# Altium schematic sheet GSM.SchDoc: GSM Sheet
size A4; ApprovedBy: Krzysztof Belewicz; CheckedBy: Krzysztof Belewicz; Author: Krzysztof Belewicz, Paweł Pieńczuk; CompanyName: Koło Naukowe Systemów Scalonych; DrawnBy: Krzysztof Belewicz; Organization: KNSS; Address1: Koło Naukowe; Address2: Systemów Scalonych; Address3: 00-665 Warszawa; Address4: Nowowiejska 15/19; DocumentNumber: 2; Revision: 1.0; SheetNumber: 3; SheetTotal: 4
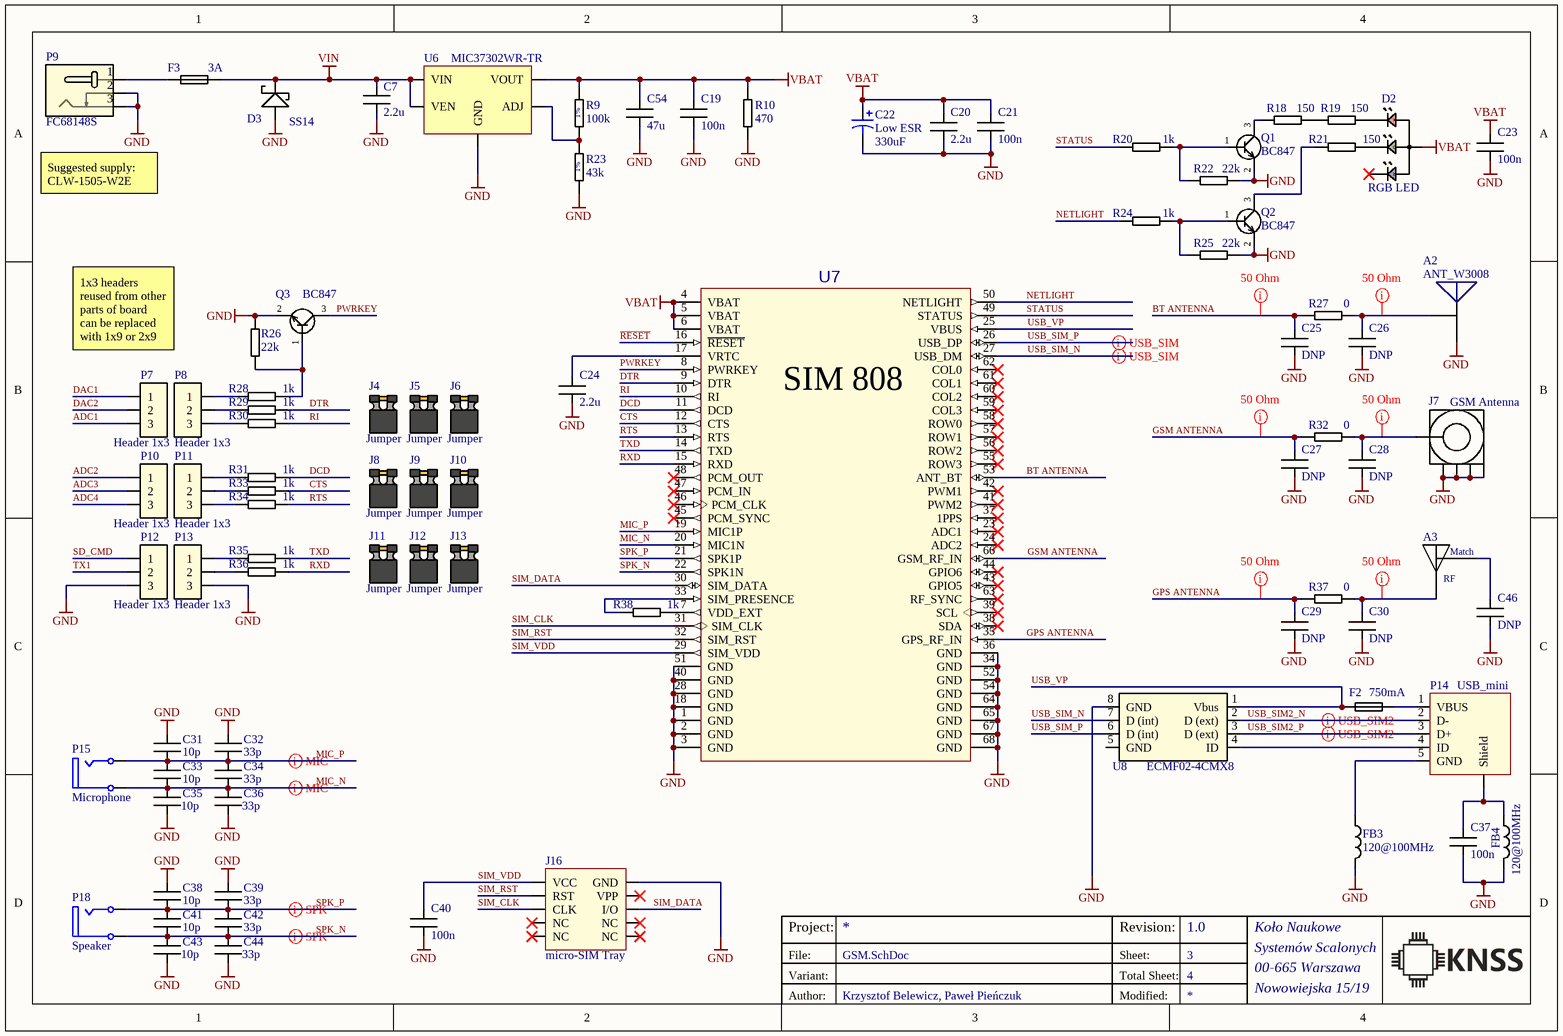
[diagram p0: GSM.SchDoc]

## Parts
A2  ANT_W3008  [W3008]
A3  GPS Antenna  [ANT3216_v2]  (value not drawn)
C7  value 2.2u  [CAPC1005N]  (hidden comment: Capacitor)
C19  100n  [CAPC1005N]
C20  value 2.2u  [CAPC1005N]  (hidden comment: Capacitor)
C21  100n  [CAPC1005N]
C22  Low ESR  value 330uF  [CAP 6.3x5.8]
C23  100n  [CAPC1005N]
C24  value 2.2u  [CAPC1005N]  (hidden comment: Capacitor)
C25  DNP  [CAPC1005N]
C26  DNP  [CAPC1005N]
C27  DNP  [CAPC1005N]
C28  DNP  [CAPC1005N]
C29  DNP  [CAPC1005N]
C30  DNP  [CAPC1005N]
C31  10p  [CAPC1005N]
C32  33p  [CAPC1005N]
C33  10p  [CAPC1005N]
C34  33p  [CAPC1005N]
C35  10p  [CAPC1005N]
C36  33p  [CAPC1005N]
C37  100n  [CAPC1005N]
C38  10p  [CAPC1005N]
C39  33p  [CAPC1005N]
C40  100n  [CAPC1005N]
C41  10p  [CAPC1005N]
C42  33p  [CAPC1005N]
C43  10p  [CAPC1005N]
C44  33p  [CAPC1005N]
C46  DNP  [CAPC1005N]
C54  47u  [CAPC3216N]
D2  RGB LED  [ASMB-MTB1-0A3A2]
D3  SS14  [DO214]
F2  Stand Current: 750mA  [RESC2012N]  (hidden comment: PTC Fuse)
F3  Stand Current: 3A  [RESC2012N]  (hidden comment: PTC Fuse)
FB3  120@100MHz  [INDC1005N]
FB4  120@100MHz  [INDC1005N]
J4  Jumper  [JUMPER-B]
J5  Jumper  [JUMPER-B]
J6  Jumper  [JUMPER-B]
J7  GSM Antenna  [5.08 SMA]
J8  Jumper  [JUMPER-B]
J9  Jumper  [JUMPER-B]
J10  Jumper  [JUMPER-B]
J11  Jumper  [JUMPER-B]
J12  Jumper  [JUMPER-B]
J13  Jumper  [JUMPER-B]
J16  micro-SIM Tray  [78000-0001]
P7  Header 1x3  [Header 1x3, Male, 2.54mm, Straight, THT]
P8  Header 1x3  [Header 1x3, Male, 2.54mm, Straight, THT]
P9  FC68148S  [FC68148S]
P10  Header 1x3  [Header 1x3, Male, 2.54mm, Straight, THT]
P11  Header 1x3  [Header 1x3, Male, 2.54mm, Straight, THT]
P12  Header 1x3  [Header 1x3, Male, 2.54mm, Straight, THT]
P13  Header 1x3  [Header 1x3, Male, 2.54mm, Straight, THT]
P14  USB_mini  [MUSB-B5-S-RA-TSMT-CS1]
P15  Microphone  [jack]
P18  Speaker  [jack]
Q1  BC847  [SOT323-3AM]
Q2  BC847  [SOT323-3AM]
Q3  BC847  [SOT323-3AM]
R9  value 100k  Tolerance: 1%  [RESC1005N]  (hidden comment: Resistor)
R10  value 470  [RESC1005N]  (hidden comment: Resistor)
R18  value 150  [RESC1005N]  (hidden comment: Resistor)
R19  value 150  [RESC1005N]  (hidden comment: Resistor)
R20  value 1k  [RESC1005N]  (hidden comment: Resistor)
R21  value 150  [RESC1005N]  (hidden comment: Resistor)
R22  value 22k  [RESC1005N]  (hidden comment: Resistor)
R23  value 43k  Tolerance: 1%  [RESC1005N]  (hidden comment: Resistor)
R24  value 1k  [RESC1005N]  (hidden comment: Resistor)
R25  value 22k  [RESC1005N]  (hidden comment: Resistor)
R26  value 22k  [RESC1005N]  (hidden comment: Resistor)
R27  value 0  [RESC1005N]  (hidden comment: Resistor)
R28  value 1k  [RESC1005N]  (hidden comment: Resistor)
R29  value 1k  [RESC1005N]  (hidden comment: Resistor)
R30  value 1k  [RESC1005N]  (hidden comment: Resistor)
R31  value 1k  [RESC1005N]  (hidden comment: Resistor)
R32  value 0  [RESC1005N]  (hidden comment: Resistor)
R33  value 1k  [RESC1005N]  (hidden comment: Resistor)
R34  value 1k  [RESC1005N]  (hidden comment: Resistor)
R35  value 1k  [RESC1005N]  (hidden comment: Resistor)
R36  value 1k  [RESC1005N]  (hidden comment: Resistor)
R37  value 0  [RESC1005N]  (hidden comment: Resistor)
R38  value 1k  [RESC1005N]  (hidden comment: Resistor)
U6  Reg Lin Regulator  [S-PAK-5]  (value not drawn)
U7  SIM808  [SIM808]  (value not drawn)
U8  ECMF02-4CMX8  [uQFN-8]

## Nets
GND: A2.2(GND) C7.1 C19.1 C20.1 C21.1 C22.2 C23.1 C24.1 C25.1 C26.1 C27.1 C28.1 C29.1 C30.1 C31.2 C32.2 C35.1 C36.1 C37.1 C38.2 C39.2 C40.1 C43.1 C44.1 C46.1 C54.1 D3.1(Anode) FB3.2 FB4.2 J7.2(GND) J7.3(GND) J7.4(GND) J7.5(GND) J16.10(GND) P9.2 P9.3 P12.3 P13.3 Q1.2(E) Q2.2(E) Q3.2(E) R10.2 R22.1 R23.2 R25.1 R26.2 U6.3(GND) U7.1(GND) U7.2(GND) U7.3(GND) U7.18(GND) U7.28(GND) U7.34(GND) U7.36(GND) U7.40(GND) U7.51(GND) U7.52(GND) U7.54(GND) U7.64(GND) U7.65(GND) U7.67(GND) U7.68(GND) U8.8(GND)
VBAT: C19.2 C20.2 C21.2 C22.1 C23.2 C54.2 D2.4(A) R9.1 R10.1 U6.5(VOUT) U7.4(VBAT) U7.5(VBAT) U7.6(VBAT)
VIN: C7.2 D3.2(Cathode) F3.2 U6.1(VIN) U6.2(VEN)
ADC1: P7.3
ADC2: P10.1
ADC3: P10.2
ADC4: P10.3
BT ANTENNA: C25.2 R27.2 U7.53(ANT_BT)
CTS: R33.1 U7.12(CTS)
DAC1: P7.1
DAC2: P7.2
DCD: R31.1 U7.11(DCD)
DTR: R29.1 U7.9(DTR)
GPS ANTENNA: C29.2 R37.2 U7.35(GPS_RF_IN)
GSM ANTENNA: C27.2 R32.2 U7.66(GSM_RF_IN)
MIC_N: C33.1 C34.1 C35.2 C36.2 P15.5(S) U7.20(MIC1N)
MIC_P: C31.1 C32.1 C33.2 C34.2 P15.1(T) U7.19(MIC1P)
NETLIGHT: R24.2 U7.50(NETLIGHT)
PWRKEY: Q3.3(C) U7.8(PWRKEY)
~{RESET}: U7.16(~{RESET})
RI: R30.1 U7.10(RI)
RTS: R34.1 U7.13(RTS)
RXD: R36.1 U7.15(RXD)
SD_CMD: P12.1
SIM_CLK: J16.3(CLK) U7.31(SIM_CLK)
SIM_DATA: J16.8(I/O) U7.30(SIM_DATA)
SIM_RST: J16.2(RST) U7.32(SIM_RST)
SIM_VDD: C40.2 J16.1(VCC) U7.29(SIM_VDD)
SPK_N: C41.1 C42.1 C43.2 C44.2 P18.3(S) U7.22(SPK1N)
SPK_P: C38.1 C39.1 C41.2 C42.2 P18.2(T) U7.21(SPK1P)
STATUS: R20.2 U7.49(STATUS)
TX1: P12.2
TXD: R35.1 U7.14(TXD)
USB_SIM2_N: P14.2(D-) U8.2(D_(ext))
USB_SIM2_P: P14.3(D+) U8.3(D_(ext))
USB_SIM_N: U7.27(USB_DM) U8.7(D_(int))
USB_SIM_P: U7.26(USB_DP) U8.6(D_(int))
USB_VP: F2.1 U7.25(VBUS) U8.1(Vbus)
NetA2_1: A2.1(SIG) C26.2 R27.1
NetA3_1: A3.1(RF) C30.2 R37.1
NetA3_2: A3.2(Match) C46.2
NetC24_2: C24.2 U7.17(VRTC)
NetC28_2: C28.2 J7.1(RF) R32.1
NetC37_2: C37.2 FB4.1 P14.0(Shield)
NetD2_1: D2.1(CR) R19.1
NetD2_2: D2.2(CG) R21.1
NetF2_2: F2.2 P14.1(VBUS)
NetF3_1: F3.1 P9.1
NetFB3_1: FB3.1 P14.5(GND)
NetP8_1: P8.1 R28.2
NetP8_2: P8.2 R29.2
NetP8_3: P8.3 R30.2
NetP11_1: P11.1 R31.2
NetP11_2: P11.2 R33.2
NetP11_3: P11.3 R34.2
NetP13_1: P13.1 R35.2
NetP13_2: P13.2 R36.2
NetP14_4: P14.4(ID) U8.4(ID)
NetQ1_1: Q1.1(B) R20.1 R22.2
NetQ1_3: Q1.3(C) R18.2
NetQ2_1: Q2.1(B) R24.1 R25.2
NetQ2_3: Q2.3(C) R21.2
NetQ3_1: Q3.1(B) R26.1 R28.1
NetR9_2: R9.2 R23.1 U6.4(ADJ)
NetR18_1: R18.1 R19.2
NetR38_1: R38.1 U7.7(VDD_EXT)
NetR38_2: R38.2 U7.33(SIM_PRESENCE)

Not connected (* = marked no-connect by the designer): D2 3(CB)*; J16 4(NC)* 5(NC)* 6(NC)* 7(NC)* 9(VPP)*; U7 23(ADC1)* 24(ADC2)* 37(1PPS)* 38(SDA)* 39(SCL)* 41(PWM2)* 42(PWM1)* 43(GPIO5)* 44(GPIO6)* 45(PCM_SYNC)* 46(PCM_CLK)* 47(PCM_IN)* 48(PCM_OUT)* 55(ROW3)* 56(ROW2)* 57(ROW1)* 58(ROW0)* 59(COL3)* 60(COL2)* 61(COL1)* 62(COL0)* 63(RF_SYNC)*; U8 5(GND)

## Layout directives
rule Undefined: BT ANTENNA, GPS ANTENNA, GSM ANTENNA, NetA2_1, NetA3_1, NetC28_2
differential pair: MIC_N, MIC_P, SPK_N, SPK_P
differential pair; rule Differential Pairs Routing [Pref Gap = 12mil    Min Gap  = 6mil    Max Gap  = 20milPref Width = 12mil    Min Width  = 6mil    Max Width  = 15mil]: USB_SIM2_N, USB_SIM2_P, USB_SIM_N, USB_SIM_P

## Notes on the sheet
- (near P9) Suggested supply:
  CLW-1505-W2E
- 1x3 headers reused from other parts of board
  can be replaced with 1x9 or 2x9
- Project:
- Variant:
- File:
- Sheet:
- Revision:
- Total Sheet:
- Author:
- Modified:
- (in symbol ASMB-MTB1-0A3A2) R; G; B
- (in symbol SIM808) SIM 808

## Library data of the parts
A2 = ANT_W3008: Bluetooth / WLAN / WiFi  Ceramic Chip Antenna W x L x H (3.2 x 1.6 x 1.1 mm); Manufacturer 1: PulseLarsen; Supplier Part Number 1: 673-W3008; Manufacturer Part Number 1: W3008; Manufacturer Part Number 2: W3008; Manufacturer 2: PulseLarsen; Supplier 1: Mouser; Supplier 2: Farnell; Supplier Part Number 2: 2897223
A3 = RFECA3216060E0T: 1.575 GHz (GPS L1) 3 dBi SMD 50Ohm chip antenna, 3216 (metric) 3.2x1.6x0.6 mm; Manufacturer 1: WALSIN; ComponentLink1Description: Datasheet; ComponentLink1URL: https://www.tme.eu/pl/Document/bb417917d175048d6475e6dbd5f68e1b/1-RFECA3216060E0T.pdf; Supplier 1: TME; Supplier 2: *; Datasheet: https://www.tme.eu/pl/Document/bb417917d175048d6475e6dbd5f68e1b/1-RFECA3216060E0T.pdf; Supplier Part Number 1: RFECA3216060E0T; Supplier 1 Link: https://www.tme.eu/pl/details/rfeca3216060e0t/anteny-gps/walsin/; Manufacturer Part Number 1: RFECA3216060E0T; Impedance: 50 Ohm; Frequency: 1.575 GHz; Package: 3216 metric SMD
C7 C20 = Capacitor: 0402 SMD Capacitor; Manufacturer 1: MURATA; Manufacturer Part Number 1: GRM155R60J225ME95D; Tolerance: 10%; MaxVoltage: 6.3V; Supplier 1: Farnell; Supplier Part Number 1: 2362091; Manufacturer Part Number 2: GRT155C80J225KE01D; Manufacturer 2: MURATA; Supplier Part Number 2: 2672104; Supplier 2: Farnell
C19 C21 C23 C37 C40 = Capacitor: 0402 SMD Capacitor; Manufacturer Part Number 1: CL05B104KO5NNNC; Manufacturer 1: Samsung; Tolerance: 10%; MaxVoltage: 16V; Supplier 1: TME; Supplier 2: Farnell; Value: 100n; Supplier Part Number 1: CL05B104KO5NNNC; Manufacturer 2: Multicomp; Manufacturer Part Number 2: MC0402B104K100CT; Supplier Part Number 2: 2627343
C22 = Cap Pol3: Polarized Capacitor (Surface Mount); Manufacturer Part Number 1: TAJD337K006RNJ; Manufacturer 1: AVX; Tolerance: 10%; Max Voltage: 6.3V; Supplier 1: TME; Supplier Part Number 1: TAJD337K006R
C24 = Capacitor: 0402 SMD Capacitor; Manufacturer 1: Samsung; Manufacturer Part Number 1: CL05A225KQ5NSNC; Tolerance: 10%; MaxVoltage: 6.3V; Supplier 1: TME; Supplier Part Number 1: CL05A225KQ5NSNC; Manufacturer Part Number 2: GRT155C80J225KE01D; Manufacturer 2: MURATA; Supplier Part Number 2: 2672104; Supplier 2: Farnell
C25-C30 C46 = Capacitor: 0402 SMD Capacitor; Value: DNP
C31 C33 C35 C38 C41 C43 = Capacitor: 0402 SMD Capacitor; Manufacturer Part Number 1: VJ0402A100JXACW1BC; Manufacturer 1: VISHAY; Tolerance: 5%; MaxVoltage: 50V; Supplier 1: Farnell; Supplier 2: TME; Value: 10p; Supplier Part Number 1: 2896329; Manufacturer 2: VISHAY; Manufacturer Part Number 2: VJ0402A100FXACW1BC; Supplier Part Number 2: VJ0402A100FXACW1BC
C32 C34 C36 C39 C42 C44 = Capacitor: 0402 SMD Capacitor; Manufacturer Part Number 1: 0402N330J500CT; Manufacturer 1: WALSIN; Tolerance: 5%; MaxVoltage: 50V; Supplier 1: Farnell; Supplier 2: TME; Value: 33p; Supplier Part Number 1: 2496802; Manufacturer 2: MURATA; Manufacturer Part Number 2: GRM1555C1H330JA01D; Supplier Part Number 2: GRM1555C1H330JA01D
C54 = Capacitor: 0402 SMD Capacitor; Manufacturer Part Number 1: CL31A476MQHNNNE; Manufacturer 1: Samsung; Tolerance: 20%; MaxVoltage: 6.3V; Supplier 1: TME; Value: 47u; Supplier Part Number 1: CL05B104KO5NNNC
D2 = ASMB-MTB1-0A3A2: LED; SMD; 3528,PLCC4; RGB; 3,5x2,8x1,9mm; 115°; 20mA; Common anode; Manufacturer 1: BROADCOM; Supplier 2: TME; Supplier Part Number 2: ASMB-MTB1-0A3A2; Manufacturer Part Number 1: ASMB-MTB1-0A3A2; Manufacturer 2: BROADCOM; Supplier 1: Farnell; Manufacturer Part Number 2: ASMB-MTB1-0A3A2; Supplier Part Number 1: 2401106
D3 = SS14: Schottky Diodes; Repetitive Reverse Voltage Max, Vrrm: 40V; Forward Current, If_AV_: 1A; Forward Voltage Max, VF: 0.5...; MF: ON; Package: DO-214 Multicomp; MP: SS14; SnapEDA_Link: https://www.snapeda.com/parts/SS14/ON%20Semiconductor/view-part/?ref=snap; Availability: Unavailable; Price: None; Value: *; Supplier 1: Farnell; Supplier 2: Mouser; Supplier Part Number 1: 1467537; Supplier Part Number 2: 512-SS14
F2 = SD075-16: PTC Fuse 750mA; Manufacturer 1: ECE; Manufacturer Part Number 1: SR075-06; Max Voltage: 6V; Supplier 1: TME; Supplier Part Number 1: SR075-06
F3 = SD075-16: PTC Fuse 3A; Manufacturer 1: Bel Fuse; Manufacturer Part Number 1: 0ZCG0300FF2B; Max Voltage: 6V; Supplier 2: Mouser; Supplier Part Number 2: 530-0ZCF0300AF2C; Manufacturer 2: Bel Fuse; Manufacturer Part Number 2: 0ZCF0300AF2C; Supplier Part Number 1: 2834915; Supplier 1: Farnell
FB3 FB4 = Inductor: Ferrite Bead; Manufacturer 1: Murata; Manufacturer Part Number 1: BLM15PD121SN1D; Max Current: 1.3A; Tolerance: 25%; Supplier 1: TME; Value: 120@100MHz; Supplier Part Number 1: BLM15PD121SN1D; Manufacturer 2: Murata; Manufacturer Part Number 2: BLM15PD121SN1D; Supplier Part Number 2: 2443229; Supplier 2: Farnell
J4-J6 J8-J13 = Header Jumper Black: 1x2, 2.54mm Black header jumper; Manufacturer 1: Multicomp; Manufacturer Part Number 1: MC-2228CG; Supplier 1: Farnell; SMD: No; Supplier Part Number 1: 2834673; Socket: No; Pin count: 0; Supplier 2: TME; Supplier Part Number 2: JUMPER-B; Manufacturer 2: NINIGI; Manufacturer Part Number 2: JUMPER-B
J7 = RF2-03E-T-00-50-G: SMA Female, 90 Angle, THT, Golded, Teflon Isolated; Impedance: 50 Ohm; ComponentLink1Description: Datasheet; ComponentLink1URL: https://www.tme.eu/pl/Document/74c53656b61e9bb3afb72f34f4091d2a/RF2-03E-T-00-50-G.pdf; Supplier 1: TME; Supplier Part Number 1: SMA-15
J16 = 78800-0001: Molex 78800 Series Vertical Hinged Micro SIM Card Connector with SMT Termination; Geometry.Height: 1mm; Supplier Part Number 2: 538-78800-0001; Manufacturer 1: Molex; Manufacturer Part Number 1: 78800-0001; Datasheet Link: https://componentsearchengine.com/Datasheets/1/78800-0001.pdf; Supplier Part Number 1: MX-78800-0001; Supplier 1: TME; Supplier 2: Mouser; ComponentLink1Description: Datasheet; ComponentLink1URL: https://www.tme.eu/pl/Document/cc8261bc3a30b5a758d5b370e59e3868/MX-78800-0001.pdf; Manufacturer 2: Molex; Manufacturer Part Number 2: 78800-0001
P7 P8 P10-P13 = Header 1x3: Pin header, 1x3, 2.54mm; Manufacturer 1: CONNFLY; Manufacturer Part Number 1: DS1021-1*3SF1-1; Supplier Part Number 1: ZL201-03G; Supplier 1: TME
P9 = FC68148S: Socket; Barrel jack DC; male; 5,5/2,1mm; SMD; Manufacturer Part Number 1: DC-10AS (FC68148S); Manufacturer 1: Cliff; Max Voltage: 12VDC; Max Current: 2A; Supplier 1: TME; Supplier Part Number 1: FC68148S
P14 = MUSB-B5-S-RA-TSMT-CS1: Gniazdo; USB B mini; SMT; poziome; V: USB 2.0; złocony; Manufacturer 1: ADAM TECH; Supplier 1: TME; Supplier Part Number 1: MUSB-B5-S-RA-SMT; Manufacturer Part Number 1: MUSB-B5-S-RA-TSMT-CS1; SMD: Yes; Socket: No; Pin count: 5
P15 P18 = Phonejack2: Jack Socket, 1/4" [6.5mm], Thru-Hole, Vertical, 2-Conductor Open Circuit; pin to pad: 1>3 5>4; Manufacturer 1: LUMBERG; Manufacturer Part Number 1: 1503 13 VP3; Supplier 1: TME; ComponentLink1Description: Manufacturer Link; ComponentLink1URL: http://www.cliffuk.co.uk/; Supplier Part Number 1: 1503-13VP3
Q1-Q3 = BC847AW.115: Tranzystor: NPN; bipolarny; 45V; 200mA; 200mW; SOT323; Manufacturer 1: NEXPERIA; Manufacturer Part Number 1: BC847AW.115; Supplier 1: TME; Supplier Part Number 1: BC847AW.115
R9 = Resistor: 0402 Film SMD Resistor; Manufacturer 1: ROYAL OHM; Manufacturer Part Number 1: CQ02WGF1003TCE; Power: 63mW; Supplier 1: TME; Supplier Part Number 1: CQ0402-100K-1%
R10 = Resistor: 0402 Film SMD Resistor; Manufacturer 1: ROYAL OHM; Manufacturer Part Number 1: 0402WGJ0471TCE; Tolerance: 5%; Power: 63mW; Supplier 1: TME; Supplier Part Number 1: SMD0402-470R
R18 R19 R21 = Resistor: 0402 Film SMD Resistor; Manufacturer 1: TE CONNECTIVITY; Manufacturer Part Number 1: CRGCQ0402F150R; Tolerance: 1%; Power: 0.1W; Supplier 1: Farnell; Supplier Part Number 1: 2861390; Manufacturer Part Number 2: RC0402FR-07150R; Manufacturer 2: YAGEO; Supplier 2: TME; Supplier Part Number 2: RC0402FR-07150R
R20 R24 R28-R31 R33-R36 R38 = Resistor: 0402 Film SMD Resistor; Manufacturer 1: TE CONNECTIVITY; Manufacturer Part Number 1: CRG0402J1K0; Tolerance: 1%; Power: 0.1W; Supplier 1: Farnell; Supplier Part Number 1: 1174154; Manufacturer Part Number 2: CRCW04021K00FKTDBC; Manufacturer 2: VISHAY; Supplier 2: TME; Supplier Part Number 2: CRCW04021K00FKTDBC
R22 R25 R26 = Resistor: 0402 Film SMD Resistor; Manufacturer 1: TE CONNECTIVITY; Manufacturer Part Number 1: CRGCQ0402F22K; Tolerance: 1%; Power: 0.1W; Supplier 1: Farnell; Supplier Part Number 1: 2861416; Manufacturer Part Number 2: CRCW040222K0FKTDBC; Manufacturer 2: VISHAY; Supplier 2: TME; Supplier Part Number 2: CRCW040222K0FKTDBC
R23 = Resistor: 0402 Film SMD Resistor; Manufacturer 1: Multicomp; Manufacturer Part Number 1: MCMR04X4302FTL; Power: 63mW; Supplier 2: TME; Supplier Part Number 2: SMD0402-43K-1%; Manufacturer Part Number 2: 0402WGF4302TCE; Manufacturer 2: ROYAL OHM; Supplier 1: Farnell; Supplier Part Number 1: 2073032
R27 R32 R37 = Resistor: 0402 Film SMD Resistor; Manufacturer 1: Panasonic; Manufacturer Part Number 1: ERJ-2GE0R00X; Tolerance: 1%; Power: 0.1W; Supplier 1: Farnell; Supplier Part Number 1: ERJ2GE0R00X
U6 = MIC37302WR-TR: IN: 2.25V to 6V / OUT: 1.24V to 5.5V / 3A, S-PAK-5 LDO Regulated; Manufacturer 1: MICROCHIP; Supplier 2: Mouser; ComponentLink1Description: Farnell part; ComponentLink1URL: https://pl.farnell.com/microchip/mic37302wr-tr/ldo-adj-1-24-5-5v-3a-s-pak-5/dp/2857619; Supplier Part Number 1: 2857619; Datasheet: http://www.farnell.com/datasheets/665822.pdf?_ga=2.173704416.256501906.1547231577-1368645859.1543427250; Supplier Part Number 2: 998-MIC37302WRTR; Supplier 1: Farnell; Manufacturer Part Number 1: MIC37302WR-TR; Manufacturer 2: MICROCHIP; Manufacturer Part Number 2: MIC37302WR-TR
U7 = SIM808: Manufacturer 1: Crestware; Supplier 1: TME; Manufacturer Part Number 1: SIM808; Supplier Part Number 1: SIM808; Supplier 2: Mouser; Supplier Part Number 2: 713-113990112
U8 = ECMF02-4CMX8: STMicroelectronics Common Mode Filter with ESD protection, USB compatible; Supplier 1: Farnell; Supplier Part Number 1: 2629721; Manufacturer 1: STMicroelectronics; Manufacturer Part Number 1: ECMF02-4CMX8